# EasyEDA Pro project BCI_TESTING_BOARD.eprj, board PCB3
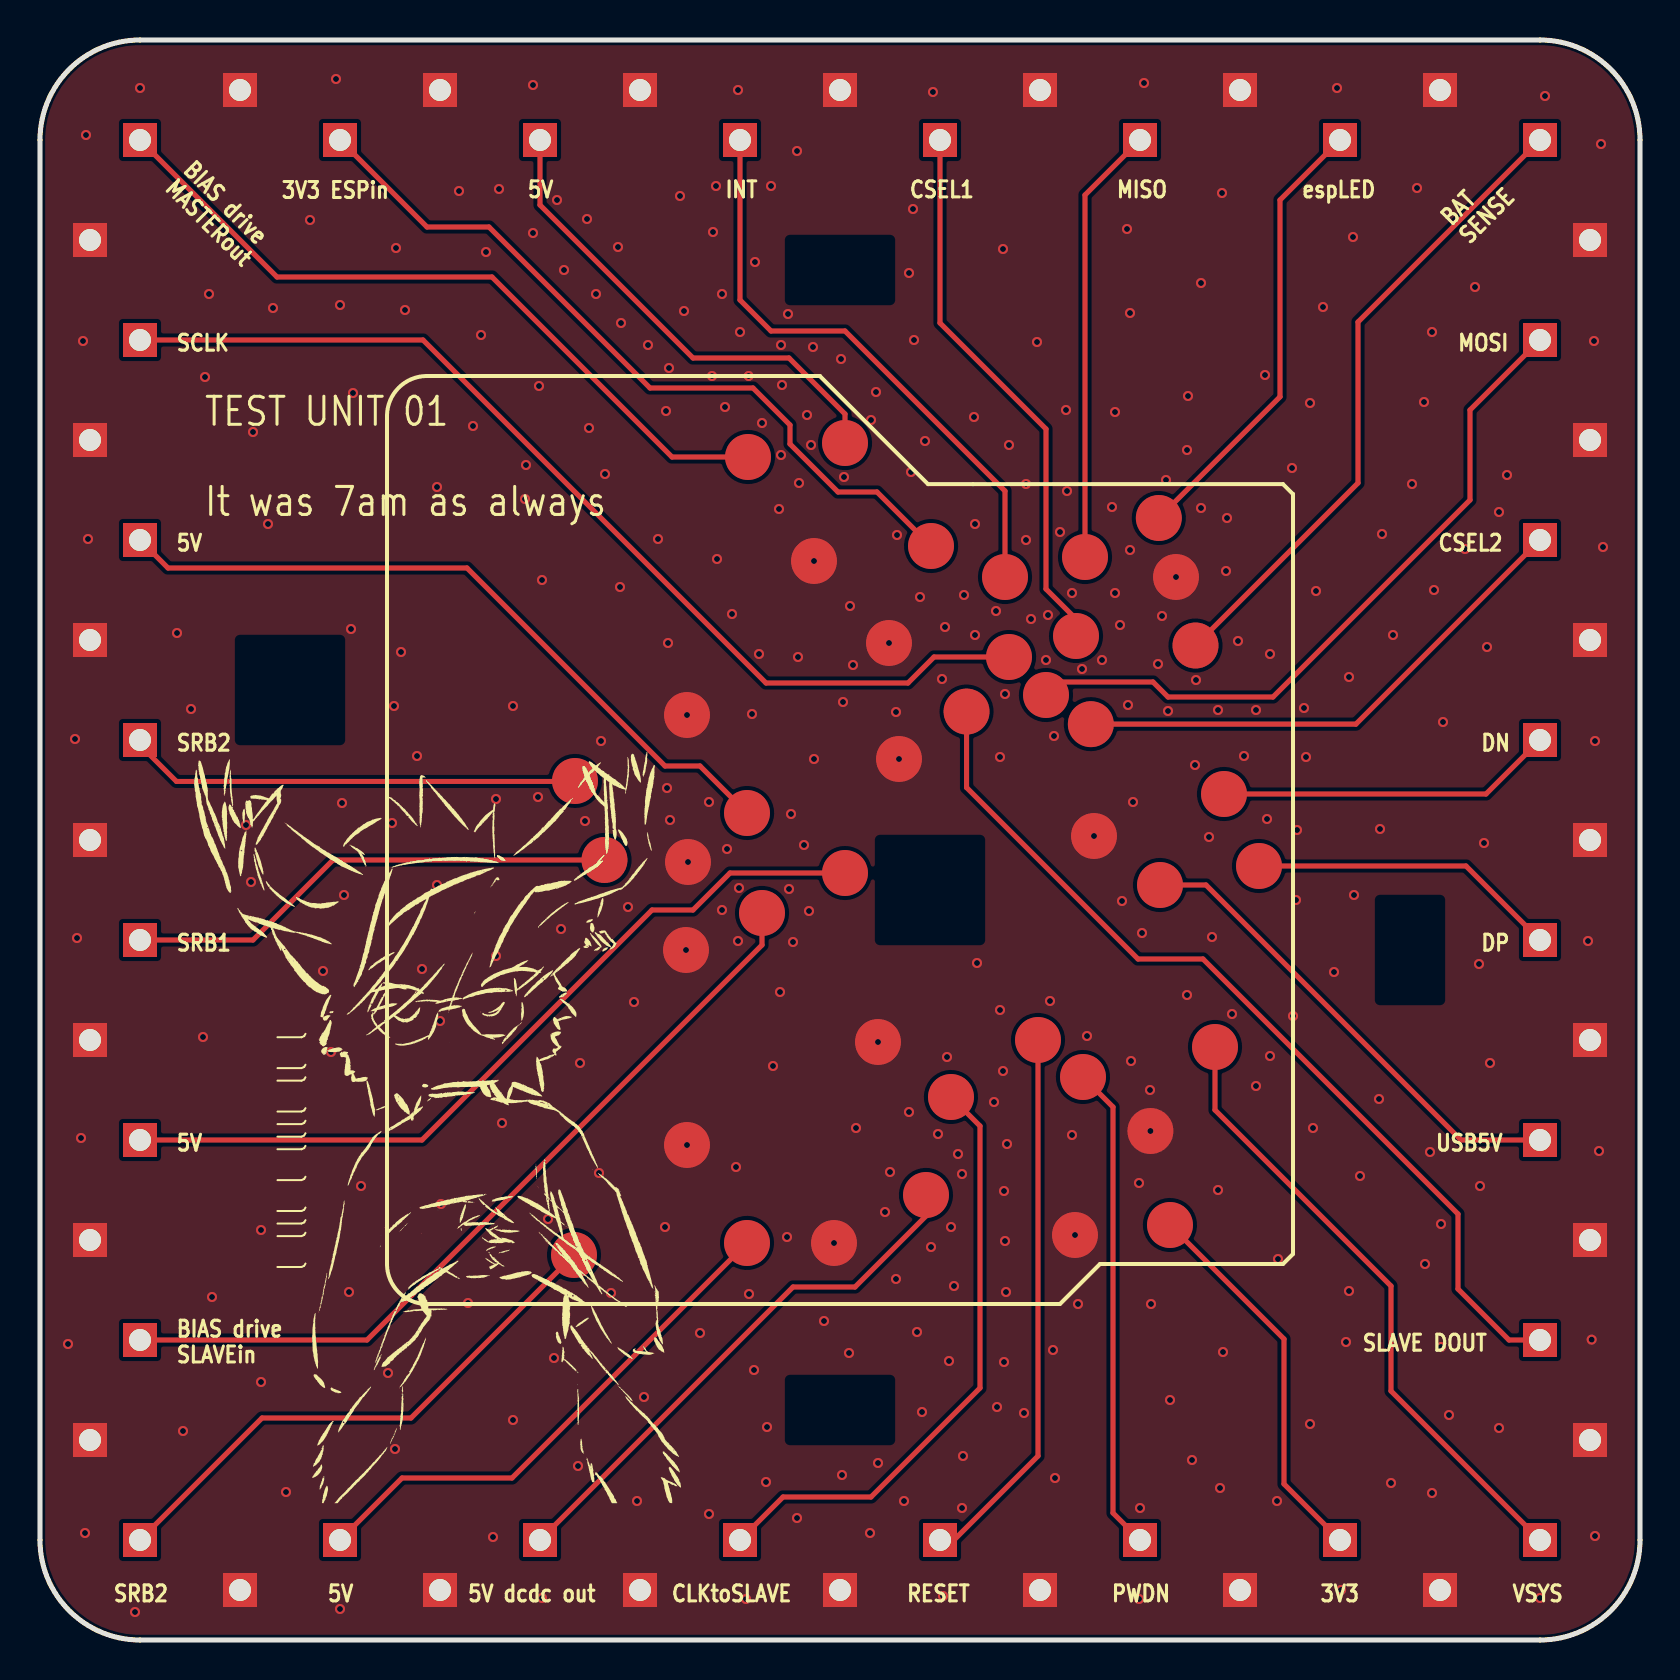
[diagram p6: board, top side]
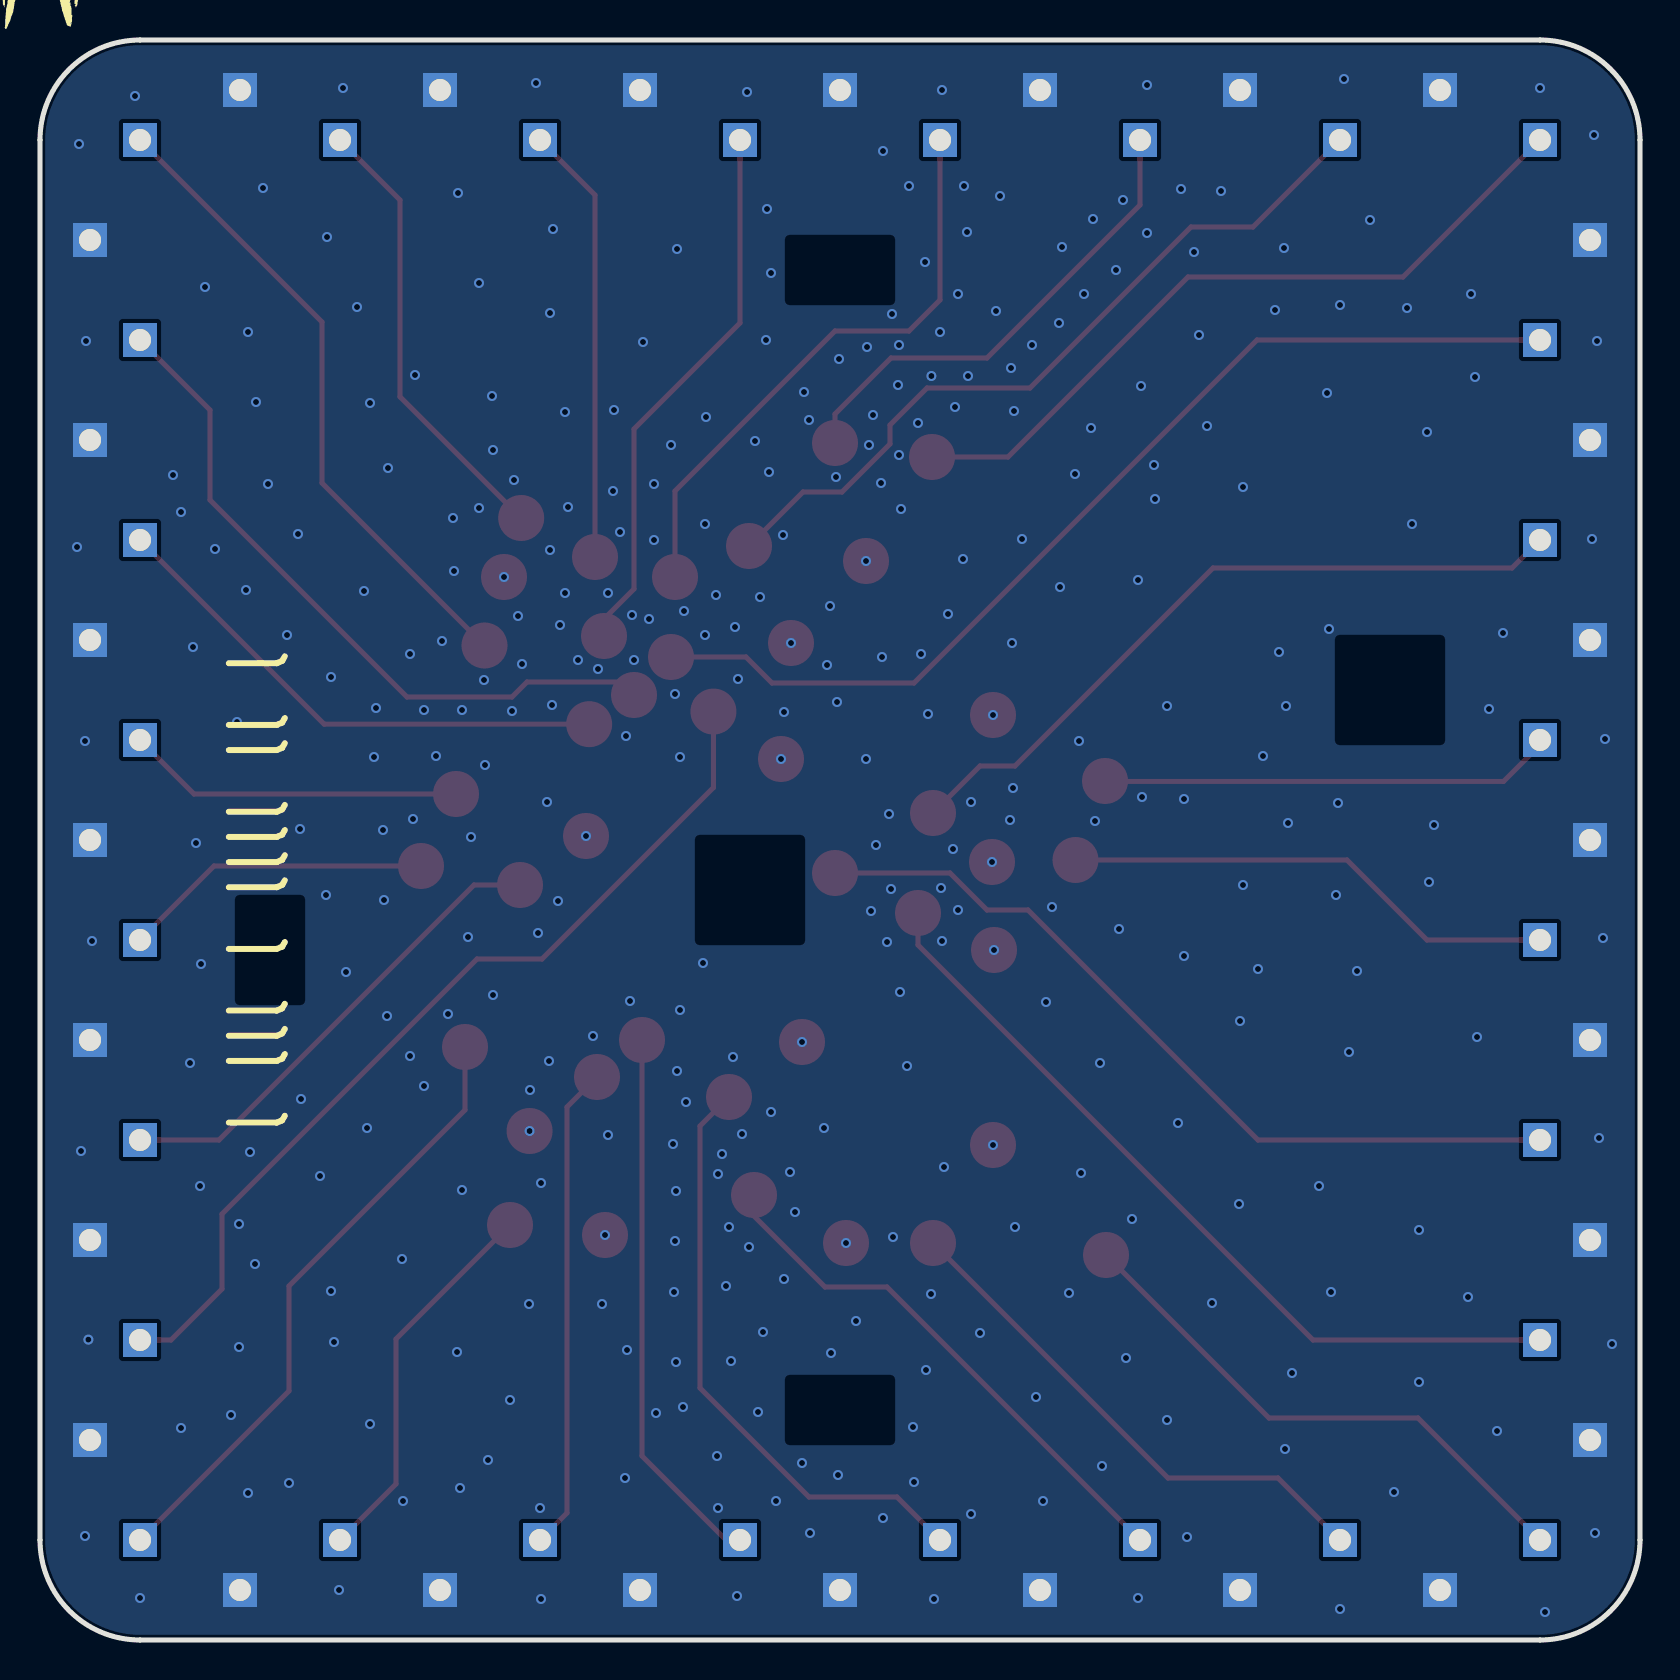
[diagram p7: board, bottom side, seen from below]

Outline 80 x 80 mm; copper layers: Top Layer, Bottom Layer. Coordinates in mm from the lower left corner of the outline.
Outline path: 0,75 0,5 arc(1.46,1.46) 5,0 75,0 arc(78.54,1.46) 80,5 80,75 arc(78.54,78.54) 75,80 5,80 arc(1.46,78.54) 0,75
Stack: Top Layer 0.035mm / Dielectric1 1.51mm FR4 er 4.5 / Bottom Layer 0.035mm

## Design rules (mm)
template: Custom Config
spacing copperThickness1oz (default): track to track 0.102, other pairs 0.152 to 0.3
spacing copperThickness2oz: track to track 0.203, other pairs 0.152 to 0.3
track width copperThickness1oz (default): min 0.127, default 0.254, max 2.54
track width copperThickness2oz: min 0.203, default 0.254, max 2.54
differential pair differentialPair (default): width min 0.127, default 0.254, max 2.54; gap min 0.152, default 0.152
via viaSize (default): diameter min 0.5, default 0.61, max 10; hole min 0.3, default 0.305, max 6.3

## Placement (name value [footprint] x y rotation side)
P2  2.54-1*1P针  [HDR-TH_1P-P2.54-V-M]  5 75 0 top
P30  2.54-1*1P针  [HDR-TH_1P-P2.54-V-M]  70 77.5 90 top
P31  2.54-1*1P针  [HDR-TH_1P-P2.54-V-M]  70 2.5 90 top
P32  2.54-1*1P针  [HDR-TH_1P-P2.54-V-M]  2.5 70 0 top
P33  2.54-1*1P针  [HDR-TH_1P-P2.54-V-M]  2.5 60 0 top
P34  2.54-1*1P针  [HDR-TH_1P-P2.54-V-M]  2.5 50 0 top
P35  2.54-1*1P针  [HDR-TH_1P-P2.54-V-M]  2.5 40 0 top
P36  2.54-1*1P针  [HDR-TH_1P-P2.54-V-M]  2.5 30 0 top
P37  2.54-1*1P针  [HDR-TH_1P-P2.54-V-M]  2.5 20 0 top
P38  2.54-1*1P针  [HDR-TH_1P-P2.54-V-M]  2.5 10 0 top
P39  2.54-1*1P针  [HDR-TH_1P-P2.54-V-M]  10 77.5 90 top
P40  2.54-1*1P针  [HDR-TH_1P-P2.54-V-M]  20 77.5 90 top
P41  2.54-1*1P针  [HDR-TH_1P-P2.54-V-M]  30 77.5 90 top
P42  2.54-1*1P针  [HDR-TH_1P-P2.54-V-M]  40 77.5 90 top
P43  2.54-1*1P针  [HDR-TH_1P-P2.54-V-M]  50 77.5 90 top
P44  2.54-1*1P针  [HDR-TH_1P-P2.54-V-M]  60 77.5 90 top
P45  2.54-1*1P针  [HDR-TH_1P-P2.54-V-M]  10 2.5 90 top
P46  2.54-1*1P针  [HDR-TH_1P-P2.54-V-M]  50 2.5 90 top
P47  2.54-1*1P针  [HDR-TH_1P-P2.54-V-M]  60 2.5 90 top
P48  2.54-1*1P针  [HDR-TH_1P-P2.54-V-M]  77.5 70 0 top
P49  2.54-1*1P针  [HDR-TH_1P-P2.54-V-M]  77.5 60 0 top
P50  2.54-1*1P针  [HDR-TH_1P-P2.54-V-M]  77.5 50 0 top
P51  2.54-1*1P针  [HDR-TH_1P-P2.54-V-M]  77.5 40 0 top
P52  2.54-1*1P针  [HDR-TH_1P-P2.54-V-M]  77.5 30 0 top
P53  2.54-1*1P针  [HDR-TH_1P-P2.54-V-M]  77.5 20 0 top
P54  2.54-1*1P针  [HDR-TH_1P-P2.54-V-M]  77.5 10 0 top
P55  2.54-1*1P针  [HDR-TH_1P-P2.54-V-M]  20 2.5 90 top
P56  2.54-1*1P针  [HDR-TH_1P-P2.54-V-M]  30 2.5 90 top
P57  2.54-1*1P针  [HDR-TH_1P-P2.54-V-M]  40 2.5 90 top
P58  2.54-1*1P针  [HDR-TH_1P-P2.54-V-M]  5 45 0 top
P59  2.54-1*1P针  [HDR-TH_1P-P2.54-V-M]  15 75 0 top
P60  2.54-1*1P针  [HDR-TH_1P-P2.54-V-M]  5 55 0 top
P61  2.54-1*1P针  [HDR-TH_1P-P2.54-V-M]  75 75 0 top
P62  2.54-1*1P针  [HDR-TH_1P-P2.54-V-M]  25 75 0 top
P63  2.54-1*1P针  [HDR-TH_1P-P2.54-V-M]  75 65 0 top
P64  2.54-1*1P针  [HDR-TH_1P-P2.54-V-M]  5 25 0 top
P65  2.54-1*1P针  [HDR-TH_1P-P2.54-V-M]  5 15 0 top
P66  2.54-1*1P针  [HDR-TH_1P-P2.54-V-M]  65 75 0 top
P67  2.54-1*1P针  [HDR-TH_1P-P2.54-V-M]  5 35 0 top
P68  2.54-1*1P针  [HDR-TH_1P-P2.54-V-M]  55 5 0 top
P69  2.54-1*1P针  [HDR-TH_1P-P2.54-V-M]  75 5 0 top
P70  2.54-1*1P针  [HDR-TH_1P-P2.54-V-M]  35 75 0 top
P71  2.54-1*1P针  [HDR-TH_1P-P2.54-V-M]  35 5 0 top
P72  2.54-1*1P针  [HDR-TH_1P-P2.54-V-M]  5 5 0 top
P73  2.54-1*1P针  [HDR-TH_1P-P2.54-V-M]  55 75 0 top
P74  2.54-1*1P针  [HDR-TH_1P-P2.54-V-M]  45 5 0 top
P75  2.54-1*1P针  [HDR-TH_1P-P2.54-V-M]  65 5 0 top
P76  2.54-1*1P针  [HDR-TH_1P-P2.54-V-M]  5 65 0 top
P77  2.54-1*1P针  [HDR-TH_1P-P2.54-V-M]  15 5 0 top
P78  2.54-1*1P针  [HDR-TH_1P-P2.54-V-M]  75 25 0 top
P79  2.54-1*1P针  [HDR-TH_1P-P2.54-V-M]  75 45 0 top
P80  2.54-1*1P针  [HDR-TH_1P-P2.54-V-M]  75 35 0 top
P81  2.54-1*1P针  [HDR-TH_1P-P2.54-V-M]  75 15 0 top
P82  2.54-1*1P针  [HDR-TH_1P-P2.54-V-M]  45 75 0 top
P83  2.54-1*1P针  [HDR-TH_1P-P2.54-V-M]  25 5 0 top
P84  2.54-1*1P针  [HDR-TH_1P-P2.54-V-M]  75 55 0 top
U17  BWCD-L5.0W2.0H2.5  [CONN-SMD_BWCD-L5.0W2.0H2.5]  35.4 59.15 0 top
U18  BWCD-L5.0W2.0H2.5  [CONN-SMD_BWCD-L5.0W2.0H2.5]  26.75 42.95 0 top
U19  BWCD-L5.0W2.0H2.5  [CONN-SMD_BWCD-L5.0W2.0H2.5]  44.55 54.7 0 top
U20  BWCD-L5.0W2.0H2.5  [CONN-SMD_BWCD-L5.0W2.0H2.5]  35.35 41.35 0 top
U21  BWCD-L5.0W2.0H2.5  [CONN-SMD_BWCD-L5.0W2.0H2.5]  57.78 49.72 0 top
U22  BWCD-L5.0W2.0H2.5  [CONN-SMD_BWCD-L5.0W2.0H2.5]  40.25 59.85 0 top
U23  BWCD-L5.0W2.0H2.5  [CONN-SMD_BWCD-L5.0W2.0H2.5]  50.3 47.25 0 top
U24  BWCD-L5.0W2.0H2.5  [CONN-SMD_BWCD-L5.0W2.0H2.5]  40.25 38.35 0 top
U25  BWCD-L5.0W2.0H2.5  [CONN-SMD_BWCD-L5.0W2.0H2.5]  36.1 36.35 0 top
U26  BWCD-L5.0W2.0H2.5  [CONN-SMD_BWCD-L5.0W2.0H2.5]  55.94 56.1 0 top
U27  BWCD-L5.0W2.0H2.5  [CONN-SMD_BWCD-L5.0W2.0H2.5]  28.22 39 0 top
U28  BWCD-L5.0W2.0H2.5  [CONN-SMD_BWCD-L5.0W2.0H2.5]  52.15 28.15 0 top
U29  BWCD-L5.0W2.0H2.5  [CONN-SMD_BWCD-L5.0W2.0H2.5]  58.75 29.65 0 top
U30  BWCD-L5.0W2.0H2.5  [CONN-SMD_BWCD-L5.0W2.0H2.5]  48.25 53.15 0 top
U31  BWCD-L5.0W2.0H2.5  [CONN-SMD_BWCD-L5.0W2.0H2.5]  45.55 27.15 0 top
U32  BWCD-L5.0W2.0H2.5  [CONN-SMD_BWCD-L5.0W2.0H2.5]  26.7 19.25 0 top
U33  BWCD-L5.0W2.0H2.5  [CONN-SMD_BWCD-L5.0W2.0H2.5]  52.25 54.15 0 top
U34  BWCD-L5.0W2.0H2.5  [CONN-SMD_BWCD-L5.0W2.0H2.5]  49.9 30 0 top
U35  BWCD-L5.0W2.0H2.5  [CONN-SMD_BWCD-L5.0W2.0H2.5]  56.5 20.75 0 top
U36  BWCD-L5.0W2.0H2.5  [CONN-SMD_BWCD-L5.0W2.0H2.5]  48.45 49.15 0 top
U37  BWCD-L5.0W2.0H2.5  [CONN-SMD_BWCD-L5.0W2.0H2.5]  35.35 19.85 0 top
U38  BWCD-L5.0W2.0H2.5  [CONN-SMD_BWCD-L5.0W2.0H2.5]  56 37.75 0 top
U39  BWCD-L5.0W2.0H2.5  [CONN-SMD_BWCD-L5.0W2.0H2.5]  59.2 42.3 0 top
U40  BWCD-L5.0W2.0H2.5  [CONN-SMD_BWCD-L5.0W2.0H2.5]  60.95 38.7 0 top
U41  BWCD-L5.0W2.0H2.5  [CONN-SMD_BWCD-L5.0W2.0H2.5]  46.33 46.42 0 top
U42  BWCD-L5.0W2.0H2.5  [CONN-SMD_BWCD-L5.0W2.0H2.5]  51.8 50.2 0 top
U43  BWCD-L5.0W2.0H2.5  [CONN-SMD_BWCD-L5.0W2.0H2.5]  44.3 22.25 0 top
U44  BWCD-L5.0W2.0H2.5  [CONN-SMD_BWCD-L5.0W2.0H2.5]  52.54 45.79 0 top
U45  BWCD-L5.0W2.0H2.5  [CONN-SMD_BWCD-L5.0W2.0H2.5]  32.35 24.75 0 top
U46  BWCD-L5.0W2.0H2.5  [CONN-SMD_BWCD-L5.0W2.0H2.5]  51.75 20.25 0 top
U47  BWCD-L5.0W2.0H2.5  [CONN-SMD_BWCD-L5.0W2.0H2.5]  38.7 53.95 0 top
U48  BWCD-L5.0W2.0H2.5  [CONN-SMD_BWCD-L5.0W2.0H2.5]  52.7 40.2 0 top
U49  BWCD-L5.0W2.0H2.5  [CONN-SMD_BWCD-L5.0W2.0H2.5]  42.95 44.05 0 top
U50  BWCD-L5.0W2.0H2.5  [CONN-SMD_BWCD-L5.0W2.0H2.5]  32.4 38.9 0 top
U51  BWCD-L5.0W2.0H2.5  [CONN-SMD_BWCD-L5.0W2.0H2.5]  56.8 53.15 0 top
U52  BWCD-L5.0W2.0H2.5  [CONN-SMD_BWCD-L5.0W2.0H2.5]  39.7 19.85 0 top
U53  BWCD-L5.0W2.0H2.5  [CONN-SMD_BWCD-L5.0W2.0H2.5]  55.52 25.45 0 top
U54  BWCD-L5.0W2.0H2.5  [CONN-SMD_BWCD-L5.0W2.0H2.5]  41.9 29.9 0 top
U55  BWCD-L5.0W2.0H2.5  [CONN-SMD_BWCD-L5.0W2.0H2.5]  32.3 34.5 0 top
U56  BWCD-L5.0W2.0H2.5  [CONN-SMD_BWCD-L5.0W2.0H2.5]  32.35 46.25 0 top
U57  BWCD-L5.0W2.0H2.5  [CONN-SMD_BWCD-L5.0W2.0H2.5]  42.45 49.85 0 top

## Footprints (pads in the part's own frame, mm; a bottom-side part is the same pattern mirrored in y, then rotated)
CONN-SMD_BWCD-L5.0W2.0H2.5
  round 2.3 smd: 1(0,0)
HDR-TH_1P-P2.54-V-M
  rect 1.7x1.7 hole 1.1: 1(0,0)

## Nets
As in the schematic.

## Via types
v1: diameter 0.5, hole 0.3, Top Layer to Bottom Layer, 353 vias

## Routing (per net, layer and track width the routed paths; a pad name or vN(x,y) marks a point on that pad's centre or on a via; arc(x,y) is an arc through that point)
GND:
  vias: v1(1.4,14.8) v1(1.75,45.05) v1(1.85,35.1) v1(2.05,25.1) v1(2.15,64.95) v1(2.25,5.35) v1(2.3,75.25) v1(2.4,55.05) v1(4.75,1.4) v1(5,77.6) v1(6.85,50.35) v1(7.15,10.45) v1(7.55,46.55) v1(8.25,63.15) v1(8.15,30.15) v1(8.45,67.3) v1(8.6,17.15) v1(10.3,40.75) v1(10.55,37.9) v1(10.65,60.4) v1(11.05,20.5) v1(11.05,12.9) v1(11.4,55.8) v1(11.65,66.6) v1(12.3,7.4) v1(13.5,71) v1(14.15,33.45) v1(14.55,29.4) v1(14.8,78.05) v1(15,66.75) v1(15,1.55) v1(15.1,41.85) v1(15.2,37.25) v1(15.55,50.55) v1(15.45,17.4) v1(15.65,62.35) v1(16.05,22.7) v1(17.4,13.35) v1(17.6,40.85) v1(17.7,46.7) v1(17.8,69.6) v1(17.75,9.55) v1(18.05,49.4) v1(18.25,66.5) v1(18.85,44.2) v1(19.1,33.55) v1(19.85,57.65) v1(19.85,37.75) v1(20,30.95) v1(20.05,21.8) v1(20.95,72.45) v1(21.4,16.85) v1(21.65,60.7) v1(22.05,65.25) v1(22.3,69.4) v1(22.65,5.15) v1(22.8,42.05) v1(22.8,34.2) v1(22.95,72.55) v1(23.1,25.85) v1(23.65,46.7) v1(23.65,11) v1(24.25,57.05) v1(24.3,58.75) v1(24.65,77.75) v1(24.65,70.35) v1(24.95,62.7) v1(24.9,42.15) v1(25.1,53) v1(25.1,2.1) v1(25.4,21.05) v1(25.7,14.1) v1(25.85,72) v1(26.05,35.55) v1(26.2,68.5) v1(26.9,8.7) v1(27,28.85) v1(27.25,40.95) v1(27.35,71.05) v1(27.45,60.6) v1(27.8,67.3) v1(27.95,23.35) v1(28.05,44.95) v1(28.25,58.3) v1(28.55,17.35) v1(28.9,69.65) v1(29,52.65) v1(29.05,65.85) v1(29.4,36.65) v1(29.7,31.9) v1(29.85,6.95) v1(30.2,12.15) v1(30.4,64.75) v1(30.9,55.05) v1(31.25,20.65) v1(31.3,61.45) v1(31.35,42.6) v1(31.45,63.6) v1(31.4,49.85) v1(31.5,41) v1(32,72.2) v1(32.2,66.45) v1(32.35,46.25) v1(32.3,34.5) v1(32.35,24.75) v1(32.4,38.9) v1(33,15.35) v1(33.45,41.9) v1(33.45,6.3) v1(33.6,63.2) v1(33.65,70.4) v1(33.8,72.7) v1(33.85,54.05) v1(34.1,67.3) v1(34.1,36.5) v1(34.25,61.65) v1(34.35,39.55) v1(34.6,51.3) v1(34.8,23.65) v1(34.9,77.5) v1(34.95,37.6) v1(34.9,34.95) v1(35,65.4) v1(35.3,2.05) v1(35.43,63.2) v1(35.45,17.3) v1(35.6,46.3) v1(35.75,68.9) v1(35.7,13.5) v1(35.95,49.3) v1(36.1,60.85) v1(36.35,10.65) v1(36.3,7.9) v1(36.55,72.7) v1(36.65,28.7) v1(36.95,56.55) v1(37,32.4) v1(37.05,64.75) v1(37.1,62.75) v1(37.05,59.25) v1(37.35,20.15) v1(37.4,66.3) v1(37.45,37.55) v1(37.55,41.3) v1(37.65,34.9) v1(37.85,74.45) v1(37.85,6.1) v1(37.95,57.85) v1(37.9,49.15) v1(38.2,39.75) v1(38.35,61.25) v1(38.45,36.45) v1(38.55,59.75) v1(38.65,64.65) v1(38.7,53.95) v1(38.7,44.05) v1(39.2,15.95) v1(39.7,19.85) v1(40.05,64.05) v1(40.1,8.25) v1(40.2,58.15) v1(40.15,46.9) v1(40.45,14.35) v1(40.5,51.7) v1(40.65,48.75) v1(40.8,25.6) v1(41.5,5.35) v1(41.55,61) v1(41.8,62.4) v1(41.9,29.9) v1(41.9,8.85) v1(42.25,21.4) v1(42.45,49.85) v1(42.5,23.4) v1(42.85,55.25) v1(42.8,46.4) v1(42.8,18.05) v1(42.95,44.05) v1(43.2,6.95) v1(43.45,68.35) v1(43.45,26.4) v1(43.55,58.4) v1(43.65,71.55) v1(43.7,65) v1(43.85,15.4) v1(44,52.15) v1(44.1,11.4) v1(44.25,59.95) v1(44.65,77.4) v1(44.55,19.65) v1(44.9,25.3) v1(45.1,48.05) v1(45.25,50.65) v1(45.15,2.2) v1(45.35,29.15) v1(45.45,13.95) v1(45.55,20.65) v1(45.7,17.7) v1(45.9,24.3) v1(46.1,23.3) v1(46.1,6.6) v1(46.2,52.25) v1(46.15,9.2) v1(46.7,61.15) v1(46.75,55.8) v1(46.75,50.25) v1(46.85,33.85) v1(47.7,26.9) v1(47.8,51.45) v1(47.85,11.65) v1(48,44.15) v1(48,31.5) v1(48.15,69.55) v1(48.25,47.3) v1(48.15,28.45) v1(48.2,22.45) v1(48.25,19.95) v1(48.2,13.9) v1(48.35,24.8) v1(48.3,17.4) v1(48.45,59.75) v1(49.2,11.35) v1(49.3,57.8) v1(49.3,55) v1(49.55,51.05) v1(49.85,64.9) v1(50.3,49) v1(50.4,51.25) v1(50.5,31.95) v1(50.7,45.2) v1(50.65,14.5) v1(50.75,8.1) v1(51,55.4) v1(51.3,61.5) v1(51.35,57.45) v1(51.6,52.35) v1(51.6,25.25) v1(51.75,20.25) v1(51.9,16.8) v1(52.1,48.55) v1(52.35,30.2) v1(52.7,40.2) v1(53.1,49) v1(53.6,56.65) v1(53.75,61.4) v1(53.75,52.35) v1(54,50.75) v1(54.1,36.95) v1(54.35,70.55) v1(54.4,46.75) v1(54.5,66.35) v1(54.5,54.5) v1(54.55,28.95) v1(54.65,41.9) v1(54.95,22.85) v1(54.95,2.05) v1(55,6.6) v1(55.1,35.35) v1(55.2,77.85) v1(55.5,27.5) v1(55.52,25.45) v1(55.55,16.8) v1(55.9,48.8) v1(56.1,51.2) v1(56.3,58) v1(56.4,46.45) v1(56.5,12) v1(56.8,53.15) v1(57.35,59.5) v1(57.35,32.25) v1(57.4,62.2) v1(57.6,9) v1(57.8,48) v1(57.75,43.75) v1(58.05,67.85) v1(58.05,56.6) v1(58.45,40.15) v1(58.6,35.15) v1(58.9,46.5) v1(58.9,22.5) v1(59,7.6) v1(59.1,72.35) v1(59.15,14.4) v1(59.35,56.1) v1(59.3,53.45) v1(59.6,31.3) v1(59.9,49.95) v1(60.2,44.2) v1(60.8,46.5) v1(60.8,27.7) v1(61.25,63.25) v1(61.35,41.05) v1(61.5,49.3) v1(61.5,29.2) v1(61.85,6.95) v1(61.9,19.05) v1(62.6,58.6) v1(62.65,31.2) v1(62.85,40.5) v1(62.8,37) v1(63.2,46.6) v1(63.3,44.15) v1(63.5,61.85) v1(63.5,10.8) v1(63.65,25.6) v1(63.8,52.45) v1(64.15,66.65) v1(64.7,33.4) v1(64.85,77.6) v1(65.05,2.5) v1(65.3,14.9) v1(65.45,48.15) v1(65.45,17.45) v1(65.65,70.15) v1(65.7,37.25) v1(66,23.2) v1(66.95,27.05) v1(67,40.55) v1(67.1,55.3) v1(67.55,7.85) v1(67.65,50.25) v1(68.6,57.8) v1(68.85,72.6) v1(69.2,61.9) v1(69.25,18.8) v1(69.5,24.4) v1(69.6,65.4) v1(69.6,7.35) v1(69.7,52.5) v1(70.05,20.8) v1(70.05,14.65) v1(70.15,45.9) v1(70.45,11.25) v1(71.25,54.55) v1(71.75,67.65) v1(71.95,33.8) v1(72,22.7) v1(72.2,39.85) v1(72.35,49.65) v1(72.5,28.85) v1(72.95,56.4) v1(72.95,10.6) v1(73.35,58.25) v1(75,2.1) v1(75.25,77.2) v1(77.4,34.95) v1(77.58,15.02) v1(77.7,64.95) v1(77.75,44.95) v1(77.75,5.2) v1(77.95,24.45) v1(78.05,74.8) v1(78.15,54.65)
17: length 22
  Top Layer w0.254: U33.1 52.25,72.25 P73.1
T1: length 37
  Top Layer w0.254: U17.1 31.6,59.15 22.6,68.15 11.85,68.15 P2.1
T2: length 22.8
  Top Layer w0.25: P58.1 5,44.75 6.82,42.93 26.73,42.93 U18.1
T3: length 38.5
  Top Layer w0.254: U19.1 41.85,57.4 39.9,57.4 37.5,59.8 37.5,60.75 35.65,62.6 30.5,62.6 22.45,70.65 19.35,70.65 P59.1
T4: length 36
  Top Layer w0.254: P60.1 6.4,53.6 21.35,53.6 31.25,43.7 33,43.7 U20.1
T5: length 32.4
  Top Layer w0.254: U21.1 65.9,57.85 65.9,65.9 P61.1
T6: length 24.3
  Top Layer w0.254: P62.1 25,71.75 32.65,64.1 37.45,64.1 40.25,61.3 U22.1
T7: length 35.3
  Top Layer w0.254: P63.1 71.5,61.5 71.5,57 61.65,47.15 56.4,47.15 55.65,47.9 50.95,47.9 U23.1
T8: length 40.8
  Top Layer w0.254: U24.1 34.5,38.35 32.65,36.5 30.6,36.5 19.1,25 P64.1
T9: length 40.9
  Top Layer w0.254: P65.1 16.35,15 36.1,34.75 U25.1
T10: length 22.7
  Top Layer w0.254: P66.1 62,72 62,62.16 U26.1
T11: length 24.9
  Top Layer w0.254: U27.1 14.65,39 10.65,35 P67.1
T12: length 24.3
  Top Layer w0.254: P68.1 53.65,6.35 53.65,26.65 U28.1
T13: length 31.4
  Top Layer w0.254: U29.1 58.75,26.5 67.55,17.7 67.55,12.45 P69.1
T14: length 29.5
  Top Layer w0.254: U30.1 48.25,57.45 40.25,65.45 36.55,65.45 35,67 P70.1
T15: length 30.3
  Top Layer w0.254: U31.1 47,25.7 47,12.6 41.55,7.15 37.15,7.15 P71.1
T16: length 27.6
  Top Layer w0.254: P72.1 11.1,11.1 18.55,11.1 U32.1
T18: length 27.4
  Top Layer w0.254: U34.1 49.9,9.2 45.7,5 P74.1
T19: length 19.3
  Top Layer w0.254: P75.1 62.2,7.8 62.2,15.05 U35.1
T20: length 51.1
  Top Layer w0.254: U36.1 44.7,49.15 43.4,47.85 36.3,47.85 19.15,65 P76.1
T21: length 26.5
  Top Layer w0.254: P77.1 18.1,8.1 23.6,8.1 U37.1
T22: length 24.3
  Top Layer w0.254: P78.1 71.05,25 58.3,37.75 U38.1
T23: length 16.9
  Top Layer w0.254: U39.1 72.3,42.3 P79.1
T24: length 15.6
  Top Layer w0.254: P80.1 71.3,38.7 U40.1
T25: length 46.1
  Top Layer w0.254: P81.1 73.45,15 70.9,17.55 70.9,21.3 58.15,34.05 54.9,34.05 46.33,42.62 U41.1
T26: length 27.6
  Top Layer w0.254: U42.1 51.8,51.05 50.3,52.55 50.3,60.55 45,65.85 P82.1
T27: length 27.1
  Top Layer w0.254: P83.1 37.65,17.65 40.75,17.65 44.3,21.2 U43.1
T28: length 26.3
  Top Layer w0.254: U44.1 65.79,45.79 P84.1

## Copper pours and planes (outline as drawn; the poured copper is in the pictures)
GND on Top Layer: -3.15,83.15 81.85,83.15 81.85,-1.85 -3.15,-1.85
GND on Bottom Layer: -3.15,83.15 81.85,83.15 81.85,-1.85 -3.15,-1.85

## Text on the board
Bottom Silkscreen Layer: l lll l llll ll l
Top Silkscreen Layer: USB5V | BAT / SENSE | SRB1 | PWDN | DP | SCLK | 5V | SRB2 | BIAS drive / SLAVEin | 3V3 ESPin | 5V dcdc out | CLKtoSLAVE | INT | RESET | CSEL1 | MISO | espLED | 3V3 | SLAVE DOUT | CSEL2 | MOSI | DN | BIAS drive / MASTERout | VSYS | l lll l llll ll l | TEST UNIT 01 / It was 7am as always
